# EasyEDA Pro project BLDCV6.eprj, board PCB2
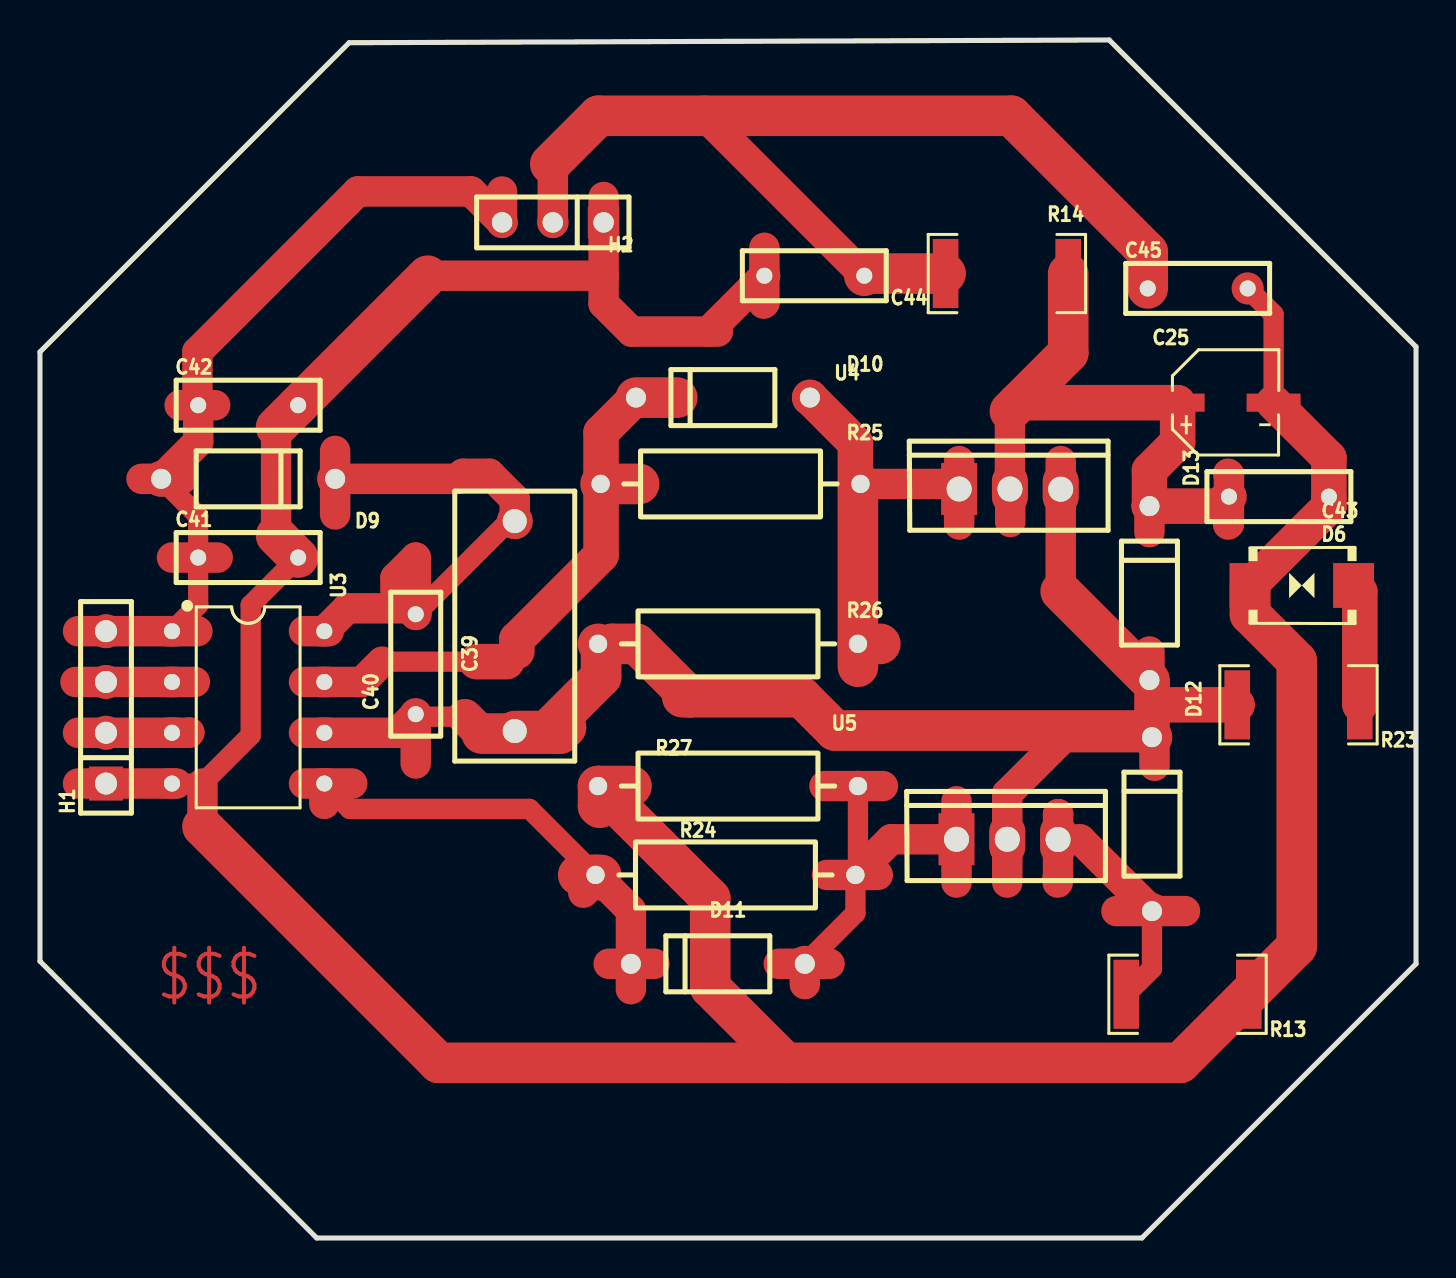
[diagram p9: board, top side]
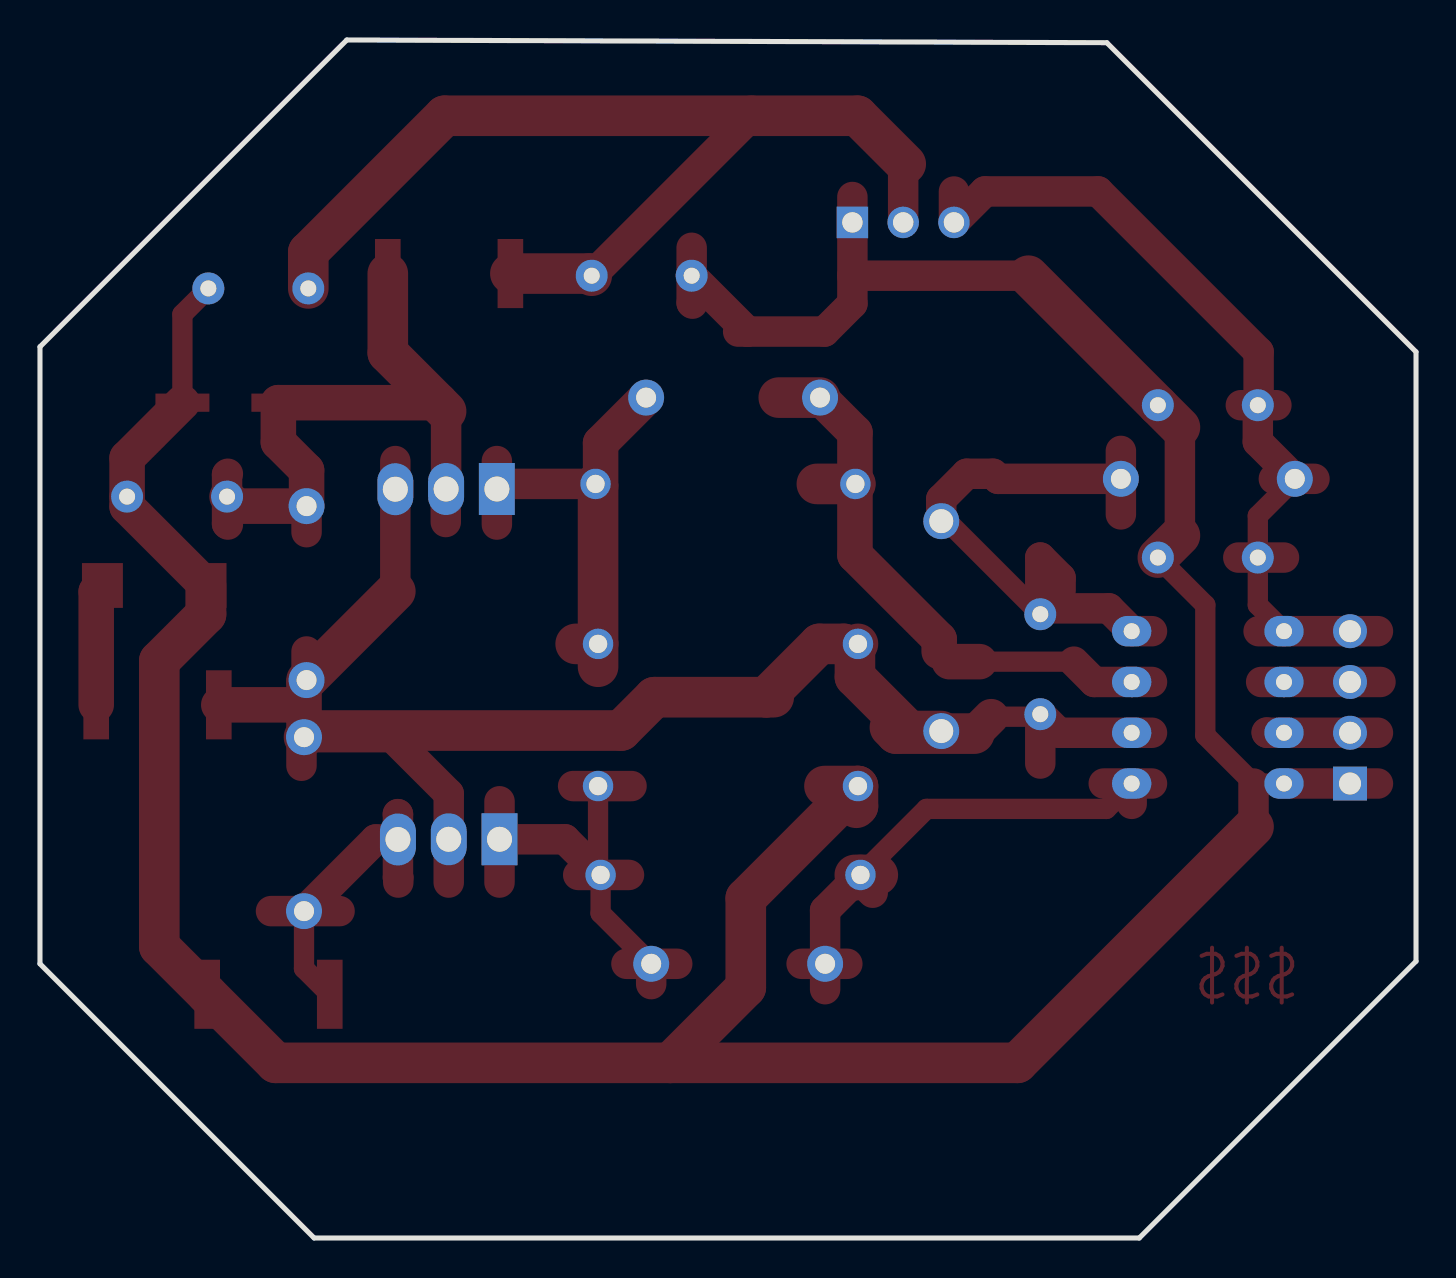
[diagram p10: board, bottom side, seen from below]

Outline 68.83 x 59.92 mm; copper layers: Top Layer, Bottom Layer. Coordinates in mm from the lower left corner of the outline.
Outline path: 0,44.32 0,13.84 13.84,0 55.12,0 68.83,13.72 68.83,44.58 53.49,59.92 15.46,59.79 0,44.32
Stack: Top Layer 0.035mm / Dielectric1 1.51mm FR4 er 4.5 / Bottom Layer 0.035mm

## Design rules (mm)
template: Custom Config
spacing copperThickness1oz (default): track to track 1, other pairs 0.152 to 0.5
spacing copperThickness2oz: track to track 0.203, other pairs 0.152 to 0.3
track width copperThickness1oz (default): min 0.127, default 0.254, max 2.54
track width copperThickness2oz: min 0.203, default 0.254, max 2.54
differential pair differentialPair (default): width min 0.127, default 0.254, max 2.54; gap min 0.152, default 0.152
via viaSize (default): diameter min 0.5, default 0.61, max 10; hole min 0.3, default 0.305, max 6.299

## Placement (name value [footprint] x y rotation side)
C25  10uF  [CAP-SMD_BD5.0-L5.3-W5.3-LS6.3-FD]  59.31 41.78 0 top
C39  15nF  [CAP-TH_L13.5-W5.5-P10.50-D1.2]  23.75 30.61 90 top
C40  100uF  [CAP-TH_L7.2-W2.5-P5.00-D0.5]  18.8 28.7 90 top
C41  470nF  [CAP-TH_L7.2-W2.5-P5.00-D0.5]  10.41 34.04 0 top
C42  470nF  [CAP-TH_L7.2-W2.5-P5.00-D0.5]  10.41 41.66 0 top
C43  470nF  [CAP-TH_L7.2-W2.5-P5.00-D0.5]  61.98 37.08 180 top
C44  470nF  [CAP-TH_L7.2-W2.5-P5.00-D0.5]  38.73 48.13 180 top
C45  470nF  [CAP-TH_L7.2-W2.5-P5.00-D0.5]  57.91 47.5 0 top
D6  P6SMB6.8CA/TR13  [SMB_L4.6-W3.6-LS5.3-BI]  63.12 32.64 0 top
D9  -  [DO-41_BD2.4-L4.7-P8.70-D0.9-RD]  10.41 37.97 180 top
D10  -  [DO-41_BD2.4-L4.7-P8.70-D0.9-RD]  34.16 42.04 0 top
D11  -  [DO-41_BD2.4-L4.7-P8.70-D0.9-RD]  33.91 13.72 0 top
D12  -  [DO-41_BD2.4-L4.7-P8.70-D0.9-RD]  55.63 20.7 270 top
D13  -  [DO-41_BD2.4-L4.7-P8.70-D0.9-RD]  55.5 32.26 270 top
H1  -  [HDR-TH_4P-P2.54-V-F]  3.3 26.54 90 top
H2  -  [HDR-TH_3P-P2.54-V-F]  25.65 50.8 180 top
R13  5mΩ  [R2512]  57.4 12.19 180 top
R14  5mΩ  [R2512]  48.37 48.24 180 top
R23  5mΩ  [R2512]  62.96 26.67 180 top
R24  11  [RES-TH_BD3.3-L9.0-P13.00-D0.6]  34.29 18.16 0 top
R25  11  [RES-TH_BD3.3-L9.0-P13.00-D0.6]  34.54 37.72 0 top
R26  11k  [RES-TH_BD3.3-L9.0-P13.00-D0.6]  34.42 29.72 180 top
R27  11k  [RES-TH_BD3.3-L9.0-P13.00-D0.6]  34.42 22.61 0 top
U3  IR2104PBF  [DIP-8_L9.9-W6.6-P2.54-LS7.62-BL]  10.41 26.54 270 top
U4  IRFZ44N  [TO-220-3_L9.9-W4.5-P2.54-L]  48.52 37.46 0 top
U5  IRFZ44N  [TO-220-3_L9.9-W4.5-P2.54-L]  48.39 19.94 0 top

## Footprints (pads in the part's own frame, mm; a bottom-side part is the same pattern mirrored in y, then rotated)
CAP-SMD_BD5.0-L5.3-W5.3-LS6.3-FD
  rect 2.7x0.91 smd: 1(-2.4,0) 2(2.4,0)
CAP-TH_L7.2-W2.5-P5.00-D0.5
  round 1.6 hole 0.8: 1(-2.5,0) 2(2.5,0)
CAP-TH_L13.5-W5.5-P10.50-D1.2
  round 1.8 hole 1.2: 1(-5.25,0) 2(5.25,0)
DIP-8_L9.9-W6.6-P2.54-LS7.62-BL
  oval 1.524x1.97 hole 0.8: 1(-3.81,-3.81) 2(-1.27,-3.81) 3(1.27,-3.81) 4(3.81,-3.81) 5(3.81,3.81) 6(1.27,3.81) 7(-1.27,3.81) 8(-3.81,3.81)
DO-41_BD2.4-L4.7-P8.70-D0.9-RD
  round 1.8 hole 1: 1(-4.35,0) 2(4.35,0)
HDR-TH_3P-P2.54-V-F
  rect 1.575x1.575 hole 1.02: 1(-2.54,0)
  round 1.575 hole 1.02: 2(0,0) 3(2.54,0)
HDR-TH_4P-P2.54-V-F
  rect 1.7x1.7 hole 1.1: 1(-3.81,0)
  round 1.7 hole 1.1: 2(-1.27,0) 3(1.27,0) 4(3.81,0)
R2512
  rect 1.282x3.456 smd: 1(-3.067,0) 2(3.067,0)
RES-TH_BD3.3-L9.0-P13.00-D0.6
  round 1.524 hole 0.914: 1(-6.5,0) 2(6.5,0)
SMB_L4.6-W3.6-LS5.3-BI
  rect 2.047x2.241 smd: 1(-2.591,0) 2(2.591,0)
TO-220-3_L9.9-W4.5-P2.54-L
  rect 1.8x2.6 hole 1.25: 1(-2.54,0.005)
  oval 1.8x2.6 hole 1.25: 2(0,0.005) 3(2.54,-0.005)

## Nets
As in the schematic.

## Routing (per net, layer and track width the routed paths; a pad name or vN(x,y) marks a point on that pad's centre or on a via; arc(x,y) is an arc through that point)
GND: length 186.3
  Top Layer w1.016: C25.2 61.71,46.2 C45.2 ; U3.4 8.13,22.73 10.54,25.15 10.54,31.66 C41.2
  Top Layer w1.524: 28.19,48.13 28.19,46.74 29.59,45.34 33.44,45.34 ; 28.19,48.13 H2.1 28.19,52.07 ; 28.19,48.13 19.39,48.13 ; U3.4 H1.1 1.91,22.73 ; 36.2,46.74 36.23,46.78 C44.2 ; 33.44,45.34 33.91,45.34 ; 33.44,45.34 C44.2 ; 8.13,20.57 8.13,22.73 ; 11.81,40.55 11.81,35.14 ; C44.2 36.23,49.53
  Top Layer w1.778: C25.2 64.48,39.02 C43.1 64.48,36.59 D6.1
  Top Layer w2.032: 11.81,35.14 C41.2 ; 37.3,8.76 33.53,12.53 33.53,16.99 R27.1 ; 37.3,8.76 19.94,8.76 8.13,20.57 ; 37.3,8.76 57.04,8.76 R13.1 62.86,14.59 62.86,28.86 60.53,31.2 D6.1 ; 19.39,48.13 C42.2 11.81,40.55 ; R27.1 29.59,22.61 ; R27.1 27.92,21.6 28,21.52
VCC: length 53.7
  Top Layer w1.524: 25.53,53.47 25.65,53.34 H2.2 ; C44.1 33.23,56.13
  Top Layer w2.032: C45.1 55.41,49.31 48.59,56.13 27.94,56.13 25.53,53.72 ; C44.1 41.34,48.24 R14.2
HS_GATE: length 24
  Top Layer w1.524: U4.1 45.73,37.72 R25.2 40.79,37.72 ; U4.1 45.98,38.86 ; U4.1 45.98,35.69
  Top Layer w1.778: 40.79,37.72 40.79,39.76 D10.2
  Top Layer w2.032: R25.2 40.92,37.59 R26.1 ; R26.1 42.04,29.72 ; R26.1 40.92,28.57
HS_SENSE: length 35.4
  Top Layer w1.524: D13.1 55.5,35.31 ; 59.44,35.69 59.48,35.73 C43.2 59.48,38.19 59.44,38.23 ; 48.54,35.81 48.54,37.45 U4.2 48.52,41.36
  Top Layer w1.778: 48.52,41.36 48.51,41.35 ; 48.94,41.78 C25.1 56.91,39.81 55.5,38.4 D13.1 59,36.61 C43.2
  Top Layer w2.032: R14.1 51.43,44.27 48.52,41.36
HSO: length 30.4
  Top Layer w1.016: 23.85,29.34 23.35,28.83 ; 21.83,28.83 17.11,28.83
  Top Layer w1.524: 17.11,28.83 16.1,27.81 U3.7 13.21,27.81
  Top Layer w1.778: 23.35,28.83 21.83,28.83 ; 23.85,29.34 23.85,29.95 28.07,34.16 28.07,40.29 D10.1
  Top Layer w2.032: D10.1 31.88,42.04 ; 29.97,37.72 R25.1
LS_GATE: length 28.7
  Top Layer w1.016: R24.2 40.79,16.25 D11.2 ; R27.2 40.92,18.29
  Top Layer w1.524: U5.1 45.85,17.78 ; U5.1 42.57,19.94 R24.2 ; U5.1 45.85,21.84 ; 42.16,22.61 R27.2 39.24,22.61 ; R24.2 41.91,18.16 ; R24.2 39.37,18.16 ; D11.2 36.96,13.72 ; D11.2 39.5,13.72 ; D11.2 38.26,12.7
LS_SENSE: length 17.7
  Top Layer w1.016: D12.2 55.63,13.48 R13.2
  Top Layer w1.524: D12.2 53.85,16.35 ; D12.2 52.04,19.93 U5.3 ; D12.2 57.28,16.35 ; U5.3 50.93,21.2 50.93,21.2 ; U5.3 50.93,18.03 50.91,18.02 50.91,17.78
LSO: length 29.9
  Top Layer w1.016: U3.5 15.49,21.46 24.49,21.46 R24.1
  Top Layer w1.524: D11.1 30.73,13.72 ; D11.1 29.56,12.45 ; D11.1 29.56,16.39 28.06,17.9 ; D11.1 28.45,13.72 ; 27.93,18.02 R24.1 27.79,17.88 27.18,17.27 ; U3.5 15.62,22.73 ; U3.5 13.21,22.73 ; U3.5 14.22,21.72
  Top Layer w2.032: 26.92,18.16 R24.1 28.07,18.16 ; 27.93,18.02 28.06,17.9
SN_SENSE+: length 89.2
  Top Layer w1.016: 21.25,26.07 18.8,26.07
  Top Layer w1.524: 48.39,17.78 U5.2 48.39,22.22 51.21,25.05 D12.1 55.75,24.92 55.75,23.62 ; C40.1 17.87,25.27 13.21,25.27 ; 18.8,26.07 18.8,23.73 ; D13.2 55.5,29.34 ; 51.06,32.35 U4.3 51.06,38.86
  Top Layer w1.778: D13.2 55.63,27.78 55.63,26.16 ; R23.2 56.13,26.67 55.63,26.16 ; 21.25,26.07 22.1,25.23 ; 55.63,26.16 D12.1
  Top Layer w2.032: C39.1 25.36,25.36 28.07,28.07 28.07,29.57 R26.2 ; D12.1 55.29,25.38 39.77,25.38 38.1,27.05 32.51,27.05 ; 32.13,27.05 32.51,27.05 ; 32.51,27.05 29.85,29.72 28.62,29.72 28.27,29.37 ; 51.06,32.35 D13.2 ; 26.32,25.54 26.01,25.23 22.1,25.23
SN_SENSE-: length 6.1
  Top Layer w1.778: 66.02,26.67 66.02,32.33 D6.2
VB: length 31.9
  Top Layer w1.016: C39.2 23.45,35.86 C40.2
  Top Layer w1.524: D9.1 20.9,37.97 21.16,38.23 22.48,38.23 23.75,36.96 C39.2 ; D9.1 14.76,39.37 ; D9.1 14.76,36.19 ; 17.78,32.38 17.78,33.02 18.8,34.04 C40.2 18.5,31.5 15.37,31.5 U3.8 13.21,30.35
$1N2679: length 6
  Top Layer w1.524: 7.75,27.81 U3.2 H1.3 1.78,27.81
$1N2682: length 5.6
  Top Layer w1.524: 1.91,25.27 7.46,25.27 7.47,25.29
$1N3599: length 48.9
  Top Layer w1.016: U3.1 7.91,31.66 C41.1 7.91,36.12 D9.2
  Top Layer w1.524: 7.87,30.35 U3.1 H1.4 1.91,30.35 ; D9.2 7.91,39.82 C42.1 ; D9.2 5.08,37.97 ; D9.2 7.11,37.97 ; C42.1 7.87,41.7 7.87,44.32 15.9,52.35 21.56,52.35 H2.3 23.11,52.34 ; C42.1 6.98,41.66 ; C42.1 8.76,41.66 ; 6.6,34.04 C41.1 8.89,34.04

## Text on the board
Top Layer: $$$
